# EasyEDA Pro project 成图大赛比赛样题参考.eprj

# Schematic SCH

## Sheets
1 P1: Create Date: 2024-05-10; Page Name: P1; Project Name: 成图大赛比赛样题参考; Schematic Name: SCH; Update Date: 2024-05-14; Company: 嘉立创EDA; Page Size: A0; Version: V1.0
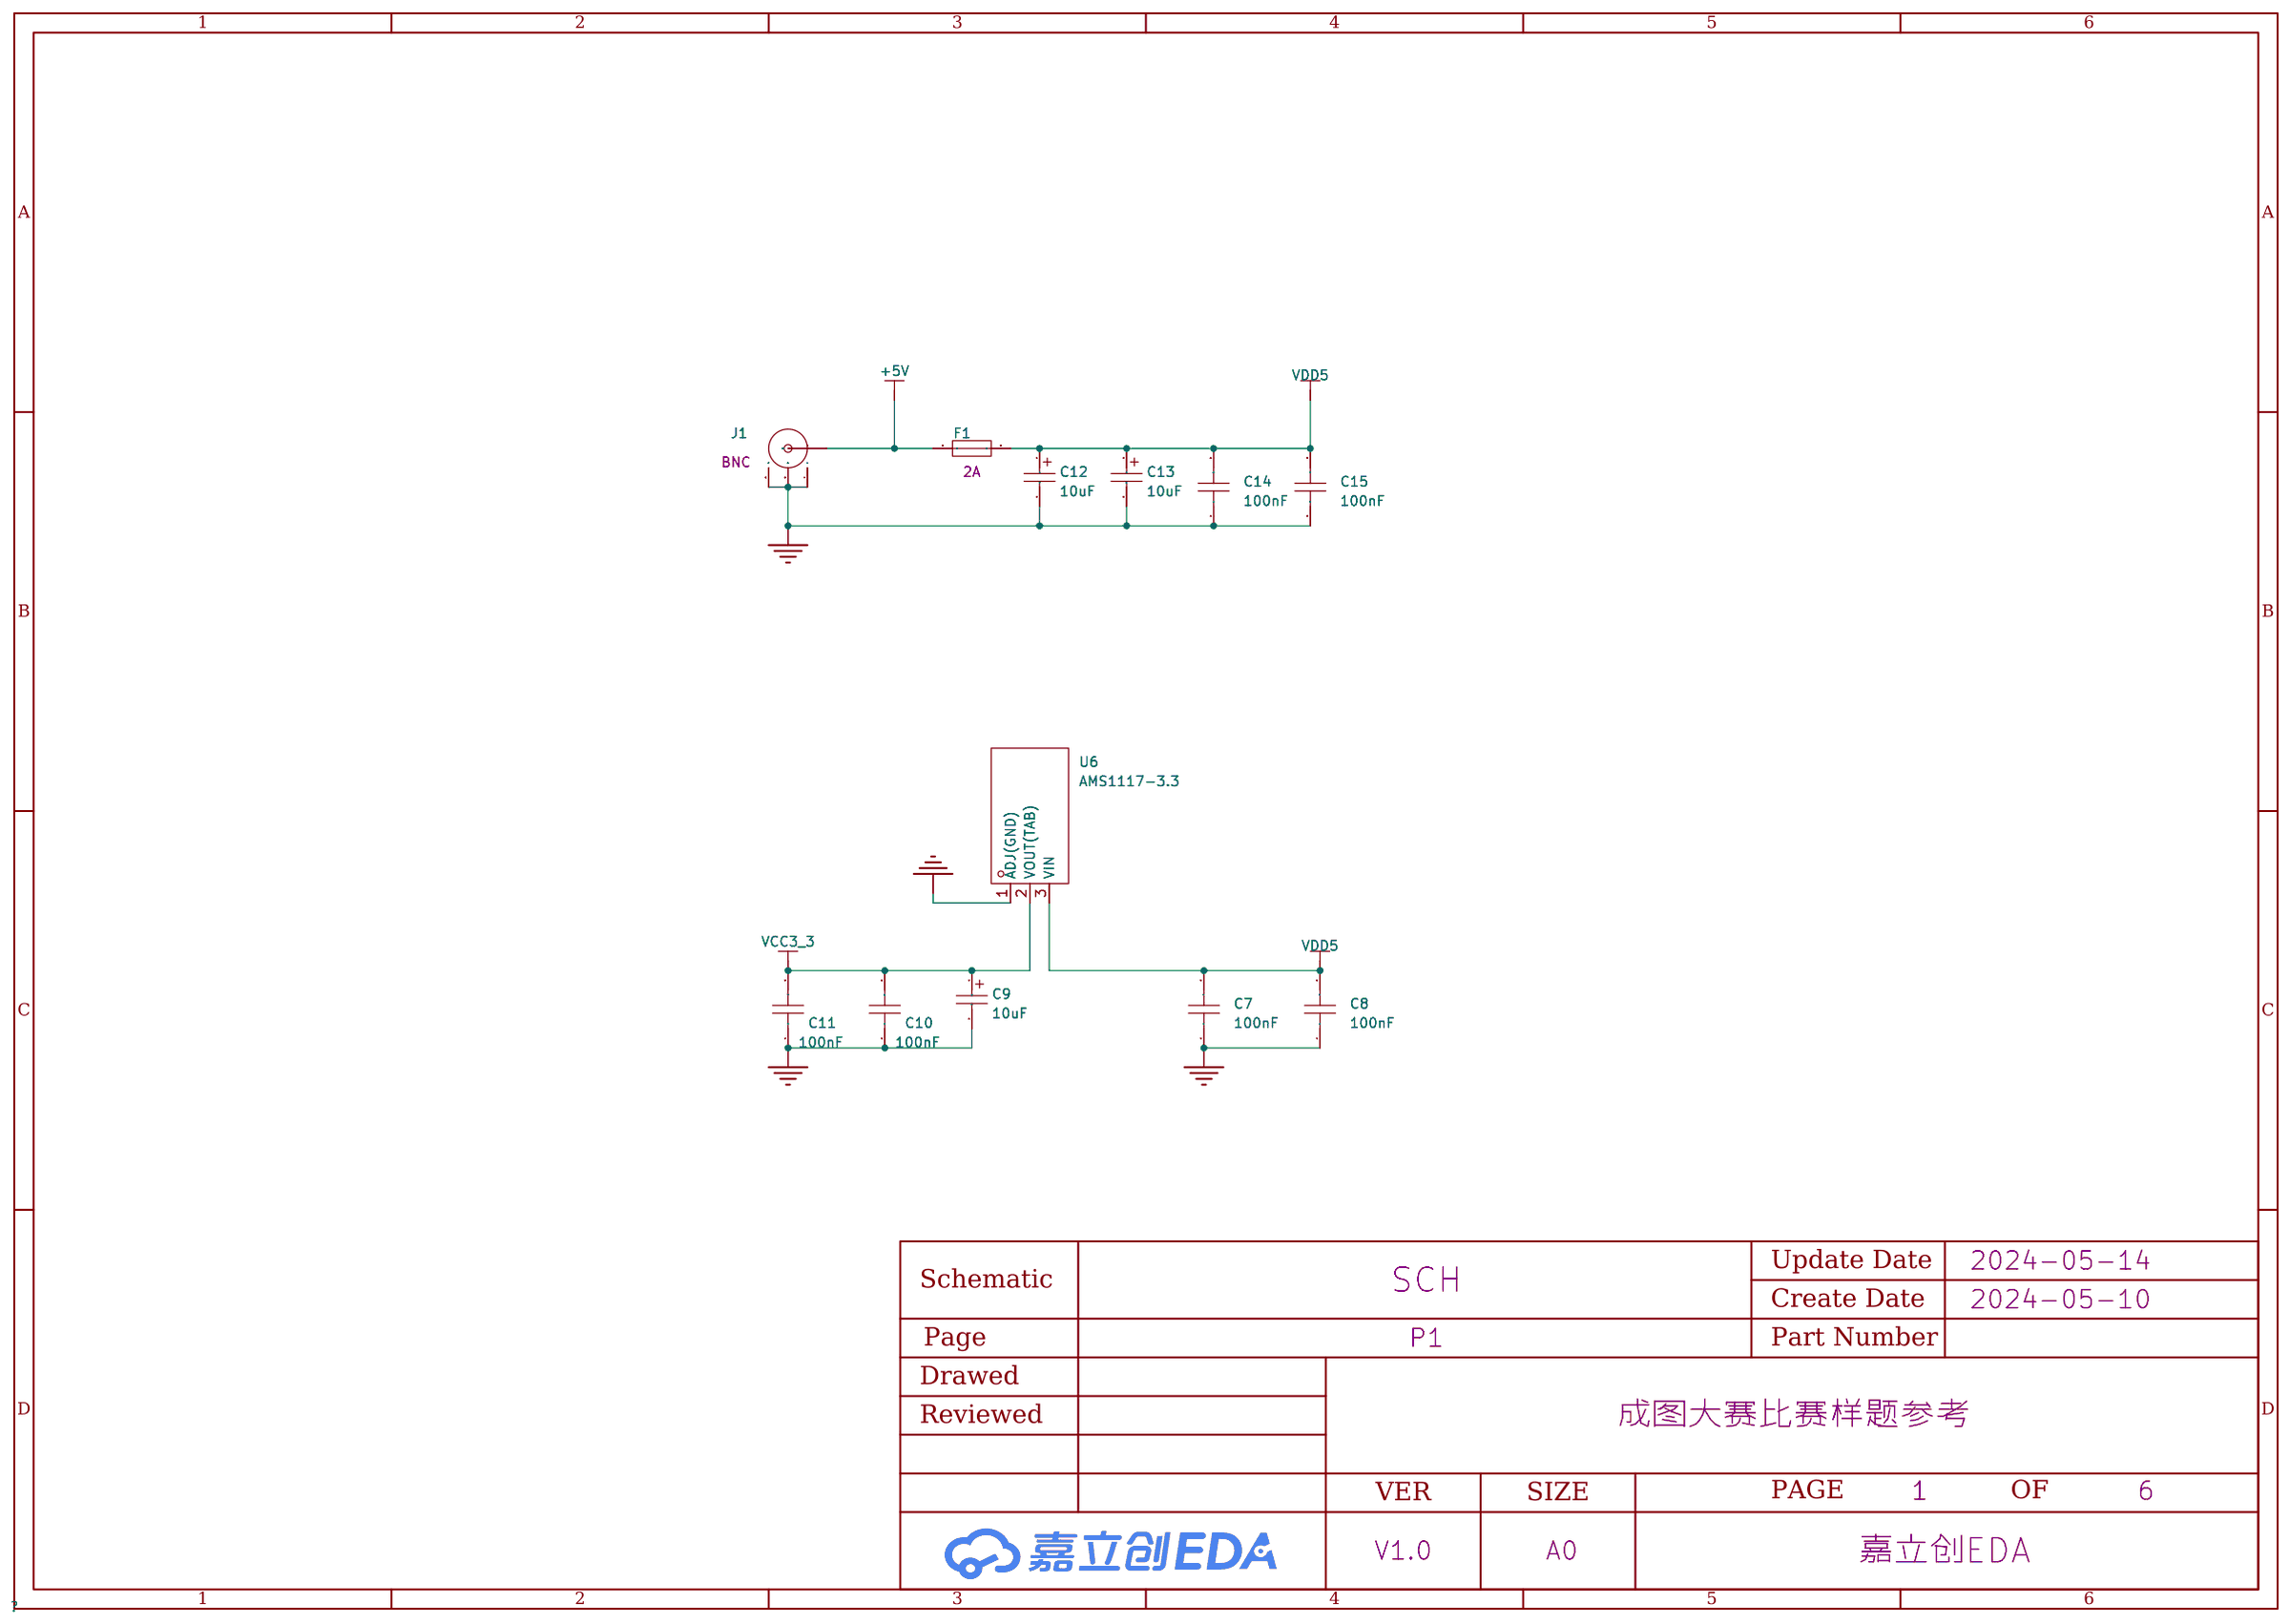
[diagram p0: P1]
2 P2: Page Name: P2
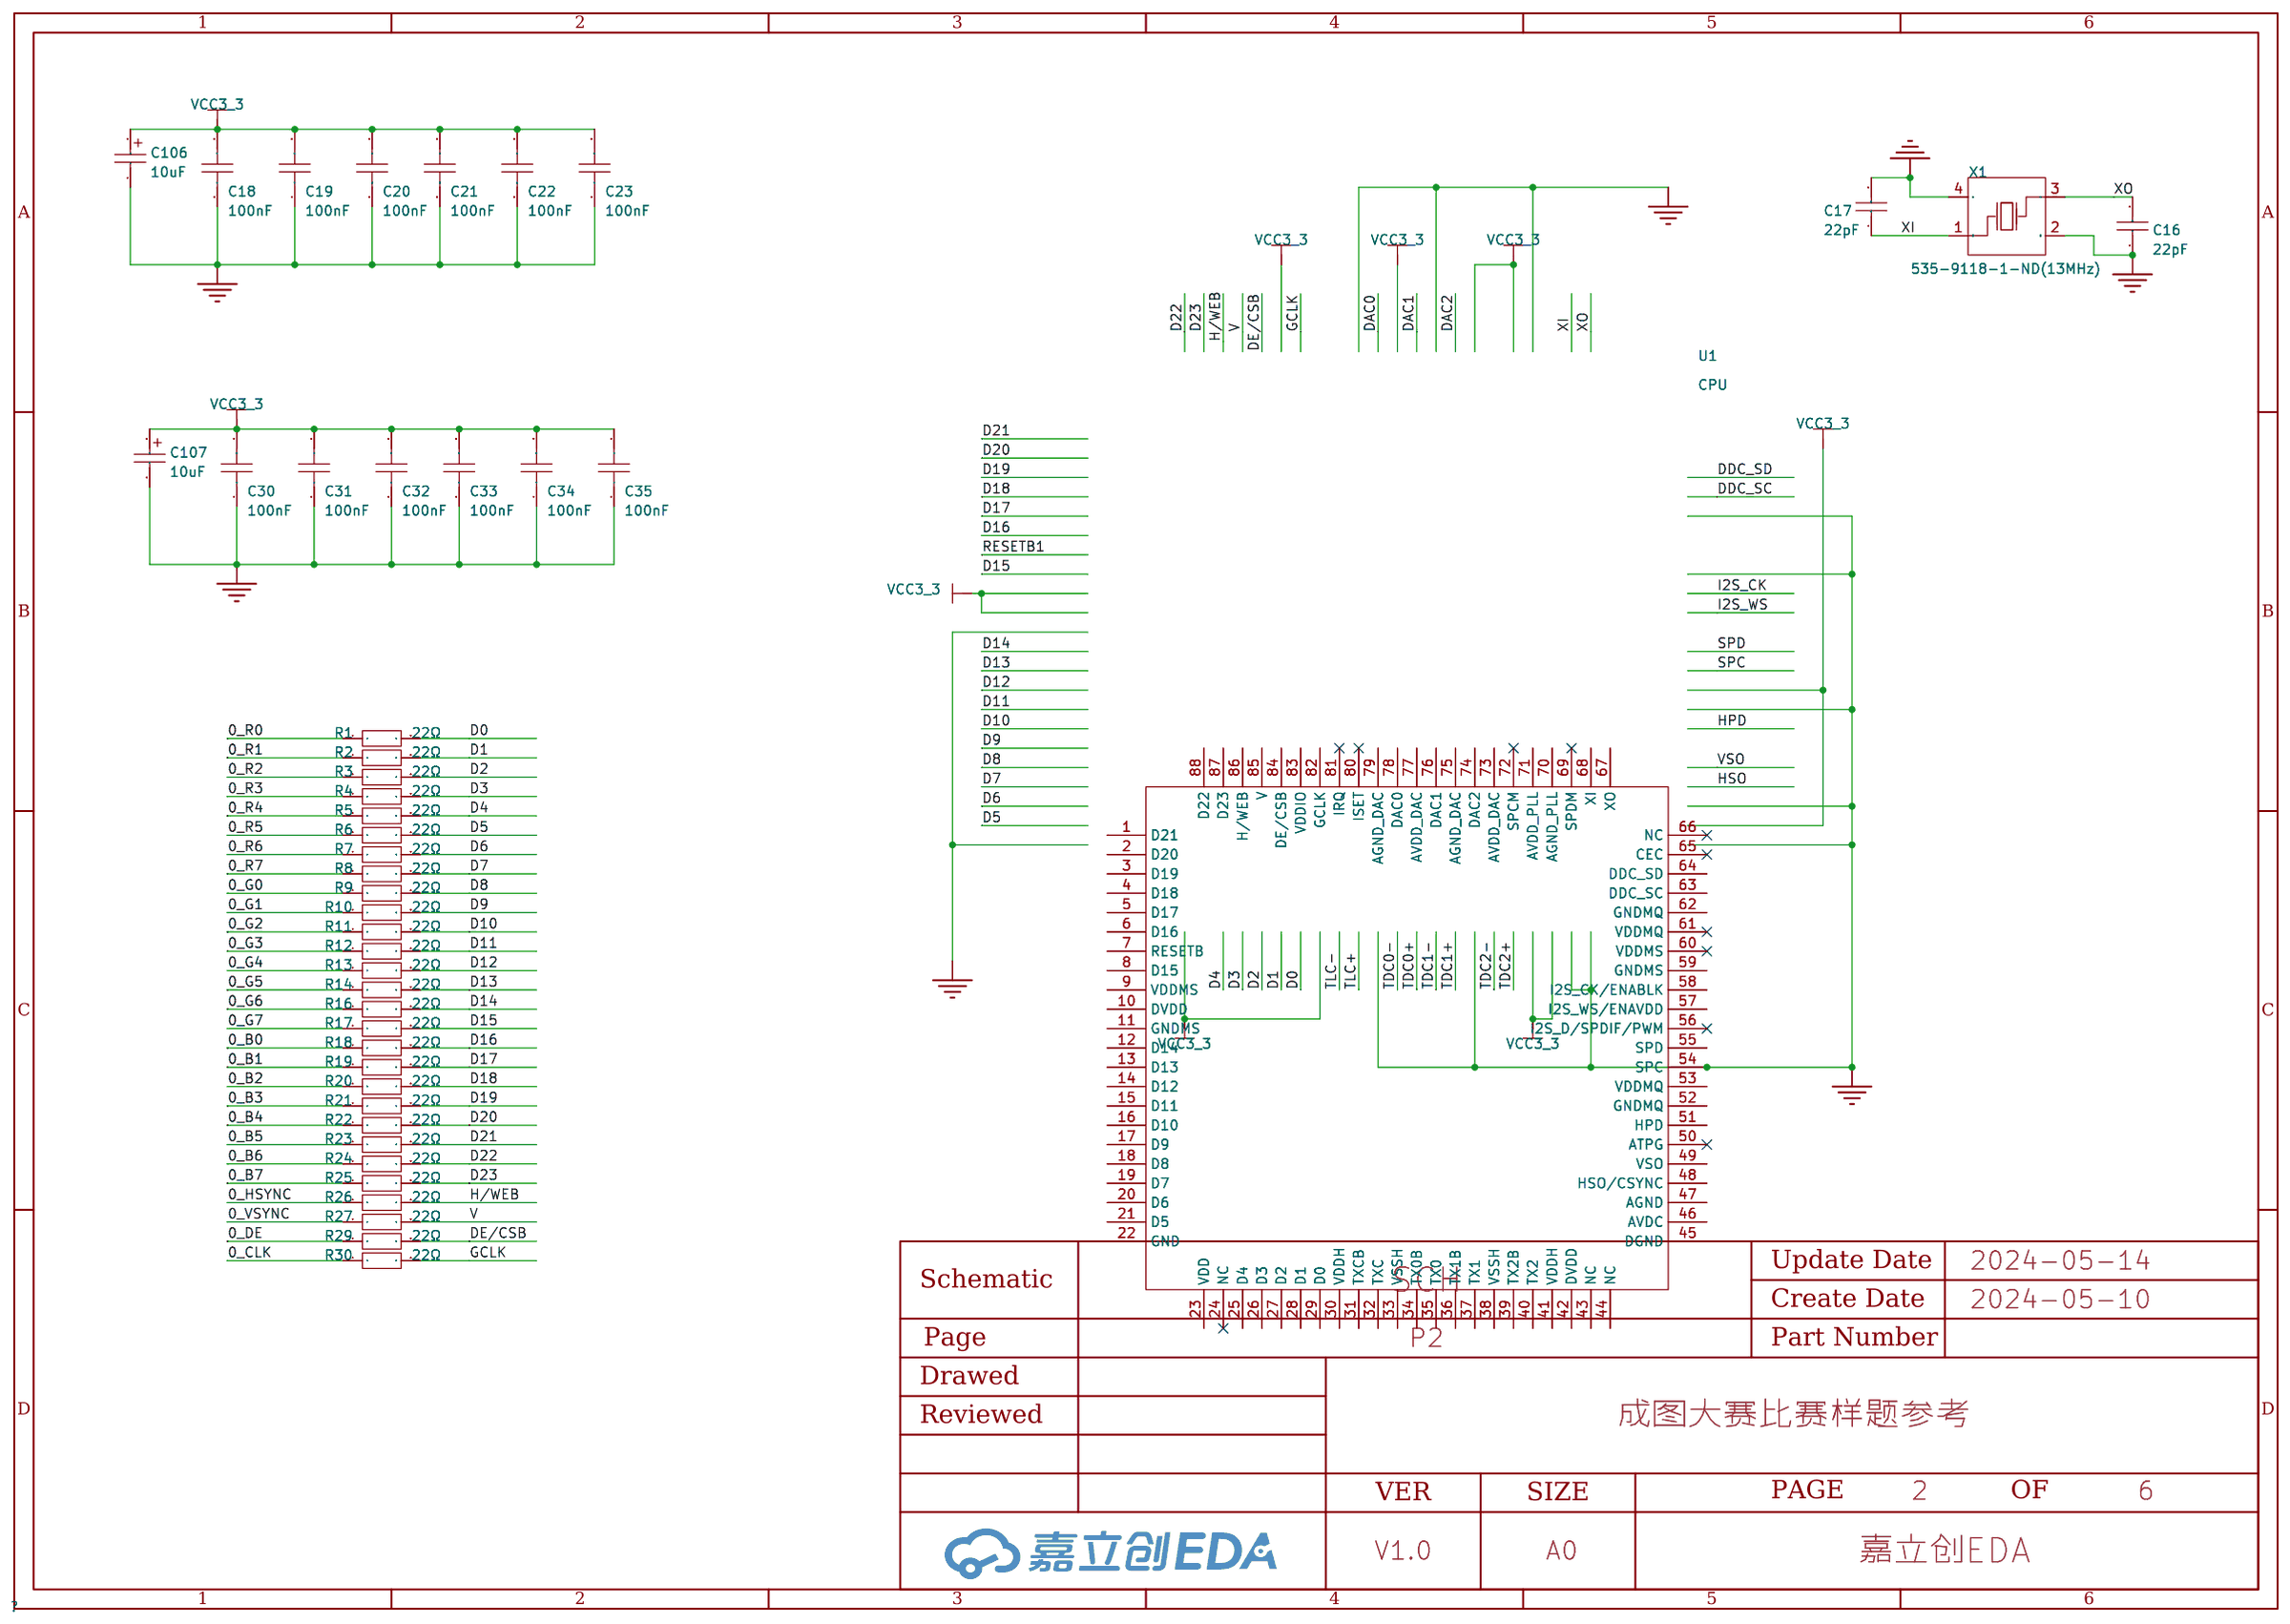
[diagram p1: P2]
3 P3: Page Name: P3
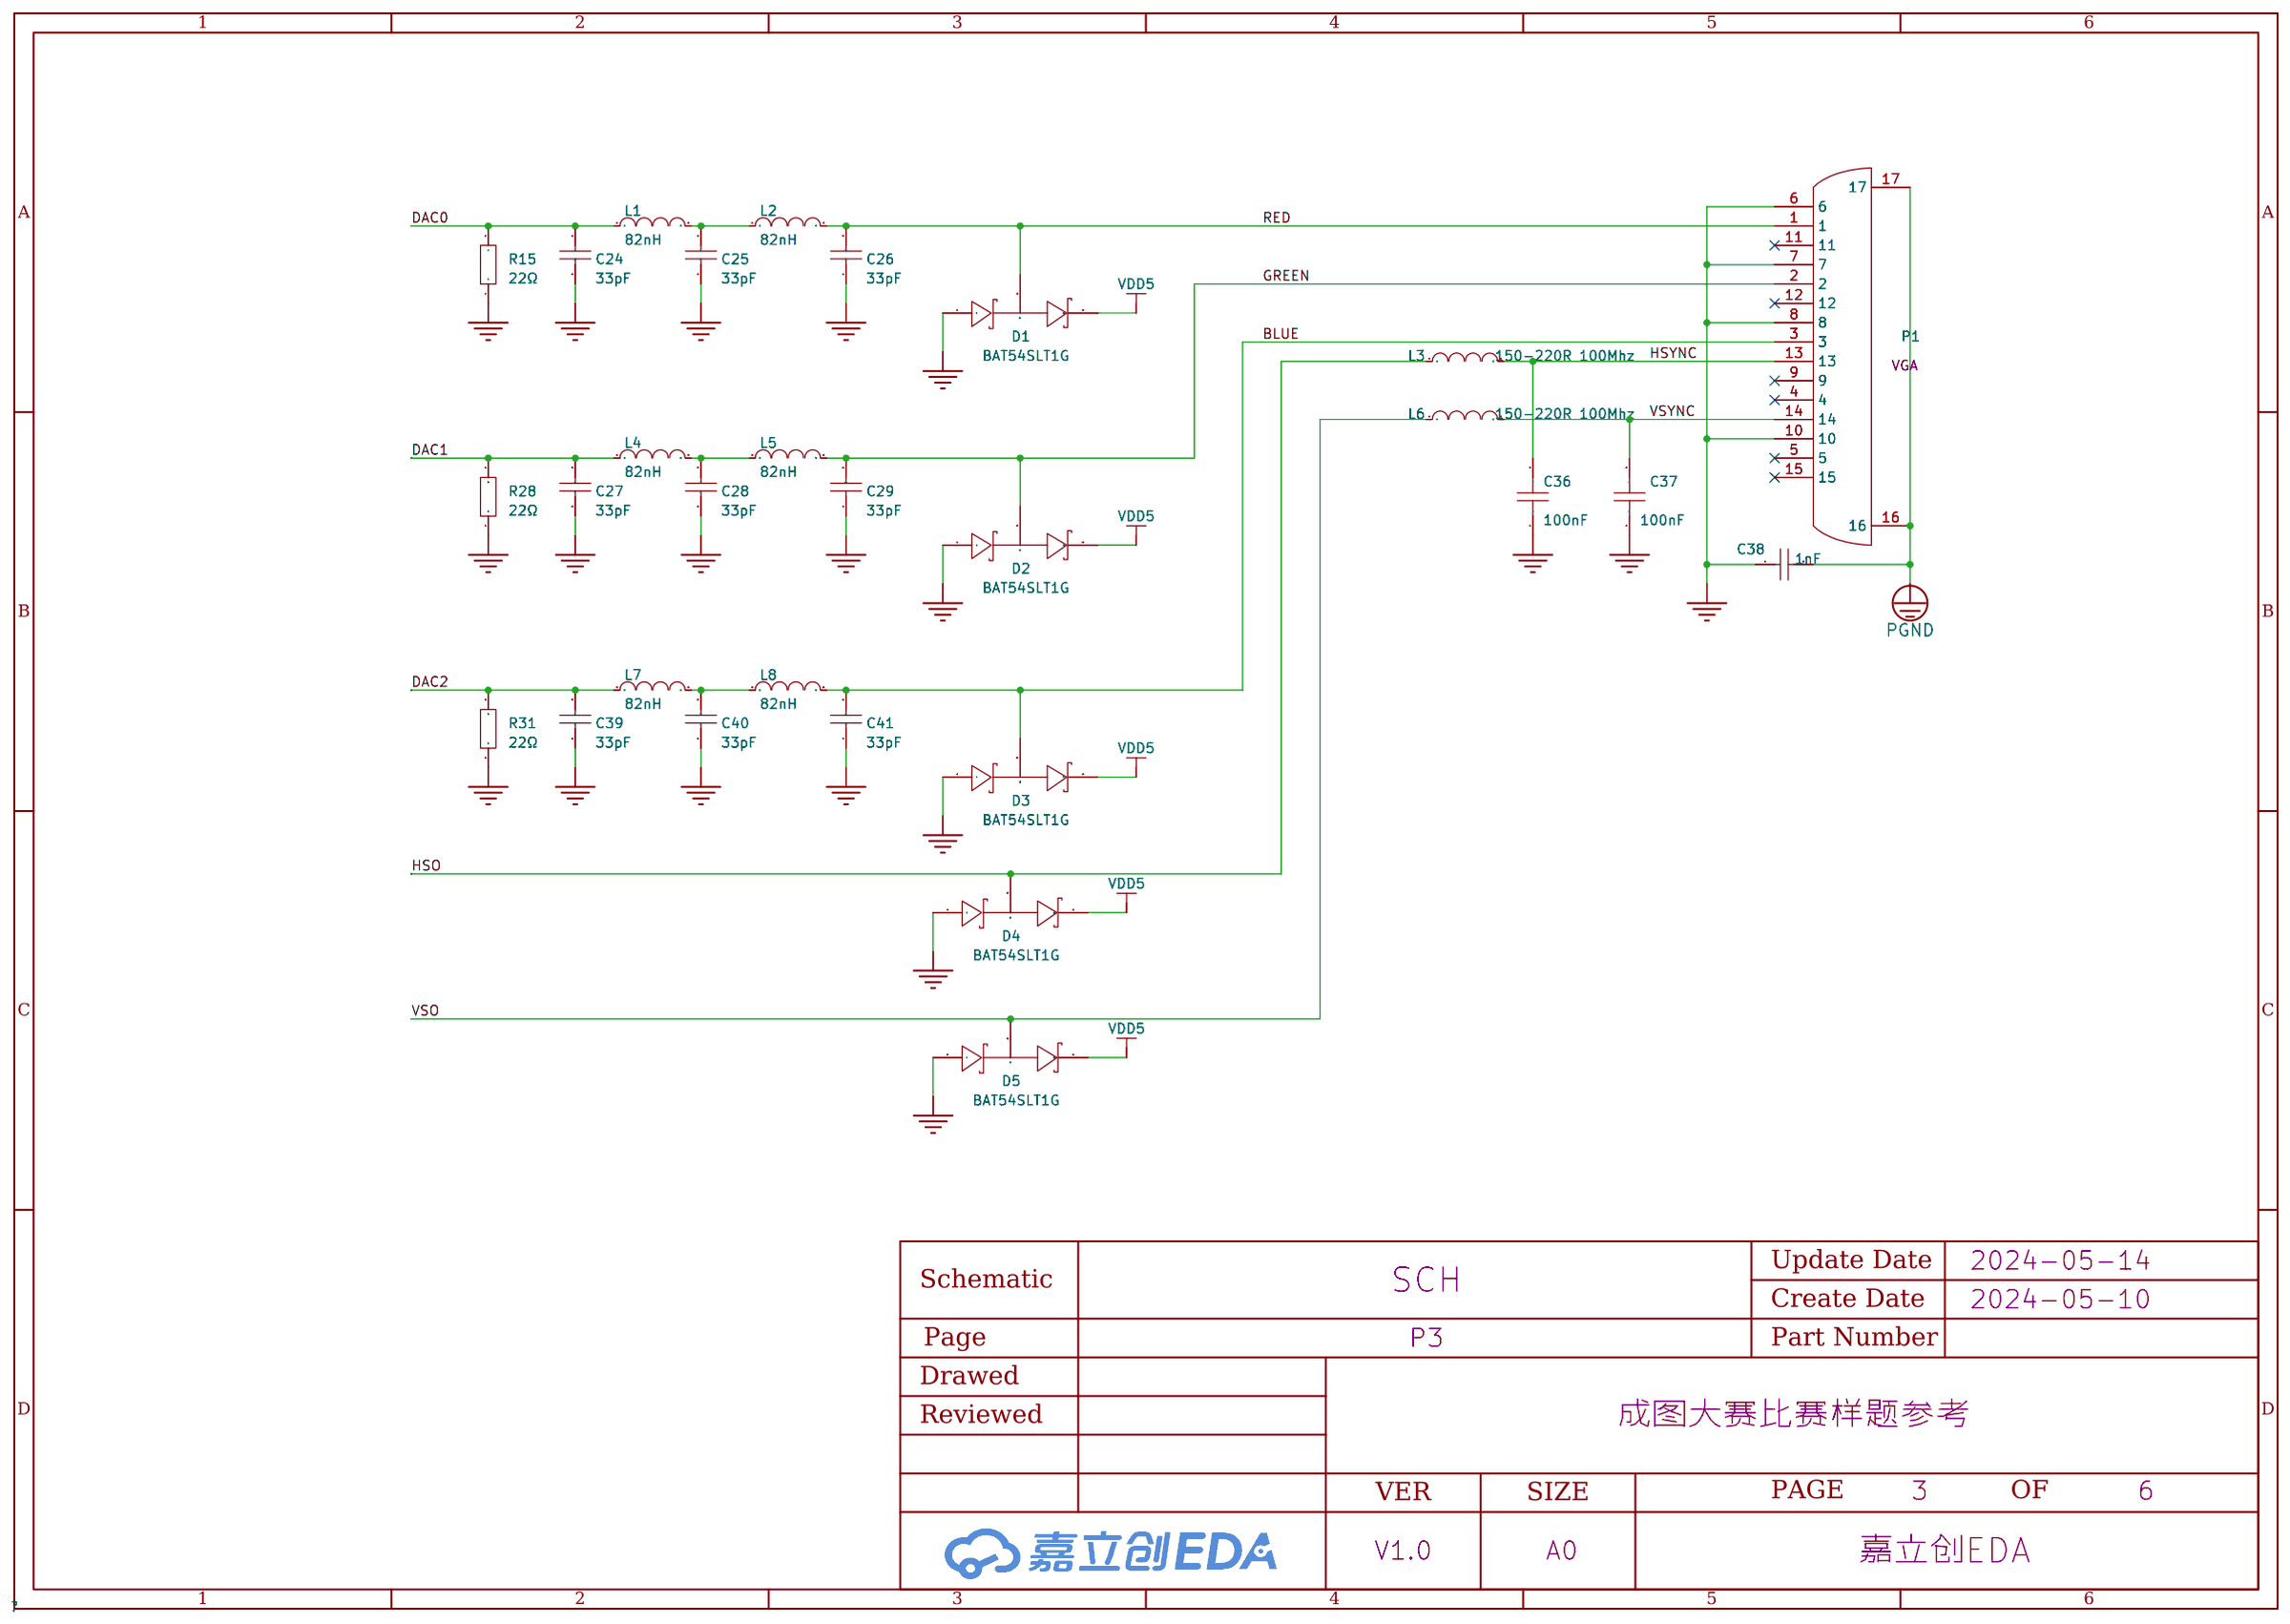
[diagram p2: P3]
4 P4: Page Name: P4
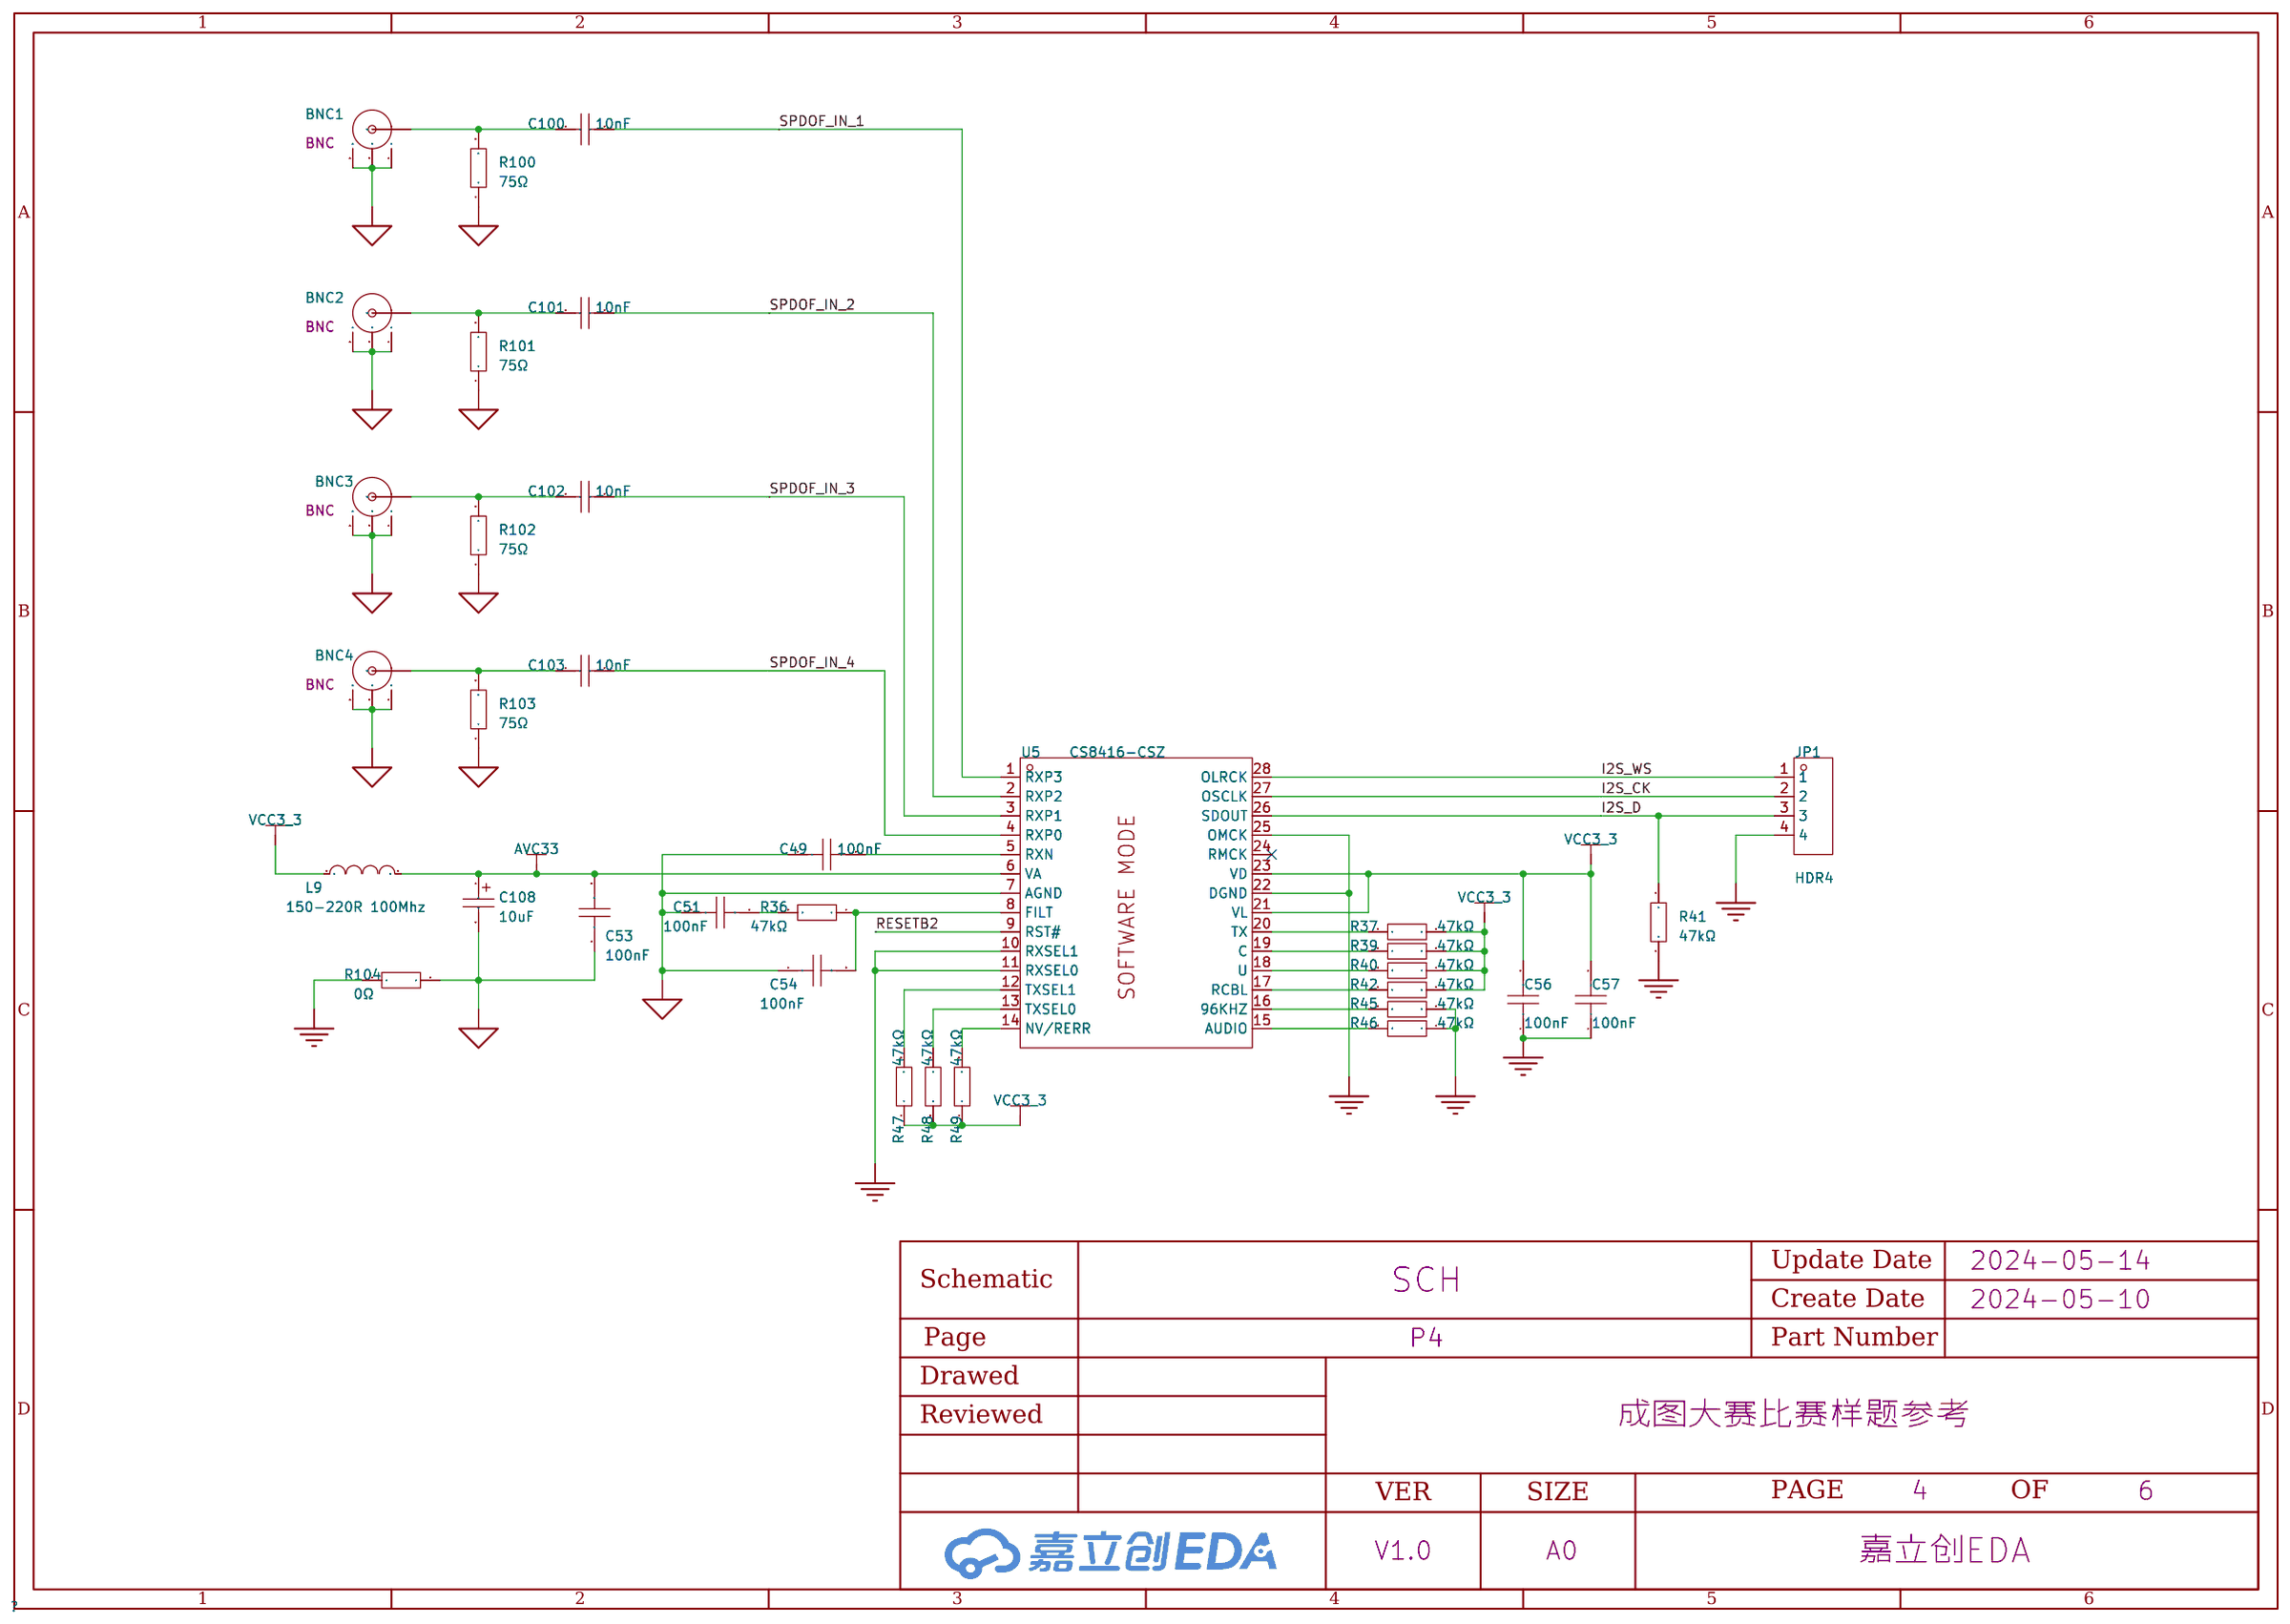
[diagram p3: P4]
5 P5: Page Name: P5